# EAGLE board BMS (EAGLE 7.5.0), part 2 of 2
## Tracks (layer width: path | path; a pad name or v marks a point on that pad's centre or on a via) (continued)
N$18 (continued)
  Top 0.406: R57.P$2 112.17,65.15 R56.P$2 119.13,66.42 119.63,65.91 120.58,65.91 | D5.A 120.8,66.73 121.06,66.98 124.43,66.98 124.79,66.62 124.79,65.99 Q8.2
N$19
  Top 0.178: 120.68,63.72 D5.C
  Top 0.406: R19.2 120.68,63.72
N$20
  Top 0.178: Q6.1 122.9,52.51 123.01,52.4 127.1,52.4 127.28,52.58 127.28,53.47 127.64,53.82 128.23,53.82 R21.1
N$21
  Top 0.178: 120.87,53.82 D6.A
  Top 0.406: R52.P$2 112.42,51.44 R53.P$2 117.25,51.44 117.68,51.87 117.68,53.47 118.03,53.82 120.87,53.82 | D6.A 121.42,54.01 121.95,54.53 124.61,54.53 124.79,54.36 124.79,53.49 Q6.2
N$22
  Top 0.178: 119.16,51.91 R22.2
  Top 0.406: D6.C 119.16,51.91
N$23
  Top 0.178: 123.63,61.65 Q7.3 123.85,61.85 123.29,62.41 123.29,64.21 123.57,64.49 125.81,64.49 126.75,65.43 129.08,65.43 129.44,65.07 129.44,64.48 R17.1 | 118.43,62.1 R19.1
  Top 0.406: R19.1 122.47,62.02 | 122.47,62.02 122.83,61.65 123.63,61.65 | R57.P$1 118.43,62.1 | F30.2 122.52,62.07 122.47,62.02
  Bottom 0.178: R56.P$1 108.55,66.42
  Bottom 0.406: 108.55,66.42 R57.P$1
N$24
  Top 0.178: Q7.1 122.9,58.56 123.19,58.27 126.75,58.27 127.1,58.62 127.1,59.16 127.28,59.33 128.31,59.33 R24.1
N$25
  Top 0.178: 121.05,59.33 D7.A | 124.79,59.34 Q7.2
  Top 0.406: R55.P$2 R54.P$2 117.6,58.55 118.39,59.33 121.05,59.33 | D7.A 121.06,60.05 121.41,60.4 124.43,60.4 124.79,60.05 124.79,59.34
N$26
  Top 0.178: 119.16,57.24 R25.2
  Top 0.406: D7.C 119.16,57.24
N$27
  Top 0.178: 118.81,55.19 R25.1 | 123.83,55.6 Q6.3 123.85,56.44 124.08,56.67 128.18,56.67 R23.1
  Top 0.406: R25.1 122.11,55.41 122.3,55.6 123.83,55.6 | 118.81,55.19 118.27,55.19 116.61,56.85 114.72,56.85 R55.P$1 114.69,53.16 F31.2
  Bottom 0.406: R54.P$1 109.31,58.55 R55.P$1
N$28
  Top 0.178: 119.1,50 R22.1
  Top 0.406: R22.1 124.03,50.08 Q5.3 126.16,50 F32.2 127.67,50.23 128.02,50.57 128.02,51.37 R20.1 | R52.P$1 118.57,48.13 119.1,48.67 119.1,50
  Bottom 0.406: R53.P$1 109.57,51.44 R52.P$1
N$29
  Top 0.178: Q5.1 123.08,48.73 123.37,49.02 125.32,49.02 125.68,49.38 127.99,49.38 128.35,49.02 128.35,48.4 R27.1
N$30
  Top 0.178: 120.91,48.31 D9.A
  Top 0.406: R51.P$2 R50.P$2 112.67,45.82 112.85,46 117.88,46 118.03,46.15 118.03,47.07 118.39,47.42 119.63,47.42 119.99,47.78 119.99,48.13 120.17,48.31 120.91,48.31 | D9.A 121.06,48.84 121.41,49.2 121.77,49.2 122.12,48.84 122.12,47.07 122.3,46.89 124.61,46.89 124.79,47.07 124.79,47.89 Q5.2
N$31
  Top 0.178: 119.16,46.07 R28.2
  Top 0.406: D9.C 119.16,46.07
N$32
  Top 0.178: 128.26,44.4 R26.1 | 112.97,41.38 R51.P$1
  Top 0.406: 128.26,44.4 126.92,44.4 126.42,43.9 Q4.3 123.51,44.23 R28.1 116.43,44.23 | 116.43,44.23 115.2,44.23 114.48,43.51 114.48,41.73 114.12,41.38 112.97,41.38 | F33.2 116.43,44.23
  Bottom 0.406: R50.P$1 109.31,44.83 R51.P$1
N$33
  Top 0.178: Q4.1 122.9,40.96 123.19,40.66 126.57,40.66 127.1,41.2 128.26,41.2 R30.1
N$34  (via drill 0.5)
  Top 0.178: D10.A 121.57,42.07 | 124.79,41.81 Q4.2
  Top 0.406: 121.57,42.07 122.12,42.8 124.61,42.8 124.79,42.62 124.79,41.81 | D10.A 119.06,42.07 v119.02,42.04 | R49.P$2 108.53,34.67 R48.P$2
  Bottom 0.406: v119.02,42.04 115.52,42.04 112.93,39.45 112.93,38.23 112.6,37.9 R48.P$2
N$35
  Top 0.178: 119.15,39.97 R31.2
  Top 0.406: D10.C 119.15,39.97
N$36
  Top 0.178: 128.28,38.53 R29.1
  Top 0.406: 126.75,38.53 125.95,39.33 Q2.3 122.26,39.33 121.92,38.84 120.45,38.84 119.81,38.35 119.06,38.35 R31.1 119.1,38.32 119.1,37.85 118.72,37.47 118.03,37.47 116.89,36.32 115.6,36.32 115.14,35.87 115.14,35.18 114.63,34.67 R49.P$1 | 126.75,38.53 128.28,38.53 | 126.75,38.53 126.75,37.57 127.33,36.98 128.7,36.98 129.18,36.5 129.18,31.8 128.83,31.45 127.53,31.45 127.38,31.6 127.38,31.63 126.72,32.3 F34.2
  Bottom 0.406: R48.P$1 108.27,37.9 R49.P$1
N$37
  Top 0.178: Q2.1 123.15,36.08 123.55,35.69 R33.1
N$38
  Top 0.406: R47.P$2 112.17,31.37 R46.P$2 113.06,31.75 117.27,31.75 117.58,32.05 117.58,35.87 118.03,36.32 119.48,36.32 119.71,36.55 119.71,36.86 120.1,37.25 D11.A 121.06,38 121.23,38.18 124.79,38.18 125.05,37.91 Q2.2
N$39
  Top 0.178: 120.93,35.27 D11.C
  Top 0.406: R34.2 120.93,35.27
N$40  (via drill 0.5)
  Top 0.178: 119.11,33.48 R34.1
  Top 0.406: R34.1 119.02,31.52 118.39,30.89 115.54,30.89 115.01,30.35 115.01,28.4 114.66,28.04 112.64,28.04 R47.P$1 | R32.1 127.74,33.48 Q1.3 119.11,33.48 | v120.88,26.09 120.88,25.73 120.35,25.2 119.42,25.2 F35.2
  Bottom 0.178: 112.64,28.04 R47.P$1
  Bottom 0.406: R46.P$1 109.31,31.37 R47.P$1 | 112.64,28.04 115.72,28.04 116.28,27.48 117.5,26.26 120.7,26.26 v120.88,26.09
N$41
  Top 0.178: Q1.1 122.62,30.67 122.94,30.35 125.04,30.35 125.27,30.58 125.27,31.37 125.53,31.45 126.82,31.45 127.08,31.19 127.08,30.43 127.36,30.15 128.79,30.15 R36.1
N$42
  Top 0.406: R45.P$2 112.45,25.02 R44.P$2 114.66,25.02 114.83,25.2 114.83,27.15 117.86,30.17 119.46,30.17 119.81,30.53 119.81,31.06 119.99,31.24 120.96,31.24 D12.A 121.06,32.13 121.41,32.49 124.26,32.49 124.43,32.31 124.43,31.47 Q1.2
N$43
  Top 0.178: 118.89,29.05 R37.2
  Top 0.406: D12.C 118.89,29.05
N$44
  Top 0.178: Q3.1 123.15,22.92 123.55,22.53 127.1,22.53 127.64,23.06 127.64,23.6 127.81,23.77 128.82,23.77 R39.1
N$45
  Top 0.178: 119.15,21.68 R40.2
  Top 0.406: D13.C 119.15,21.68
N$46
  Top 0.178: 128.16,90.89 R4.1 128.52,91.25 | 137.08,91.54 137.11,68.35 137.41,68.05 138.44,68.05 R2.1 R3.1 | 136.3,92.33 128.52,92.33 | 136.3,92.33 137.08,91.54 | 136.3,92.33 137.08,91.54
  Top 0.406: Q12.3 128.16,90.89 | 128.52,91.25 128.52,92.33 128.52,105.56 128.56,105.56 F25.2
N$47
  Top 0.178: 125.15,23.86 Q3.2 | 117.68,18.65 117.57,18.54
  Top 0.406: R43.P$2 117.57,18.54 118.03,18.08 118.03,15.36 R42.P$2 | 125.15,23.86 125.15,24.49 124.79,24.84 121.41,24.84 121.06,24.49 D13.A 118.22,23.78 117.68,23.24 117.68,18.65
N$48
  Top 0.178: R42.P$1 | R38.1 128.84,17.36 128.52,17.04 R41.1 129.06,17
  Top 0.406: R40.1 119.02,17.98 120.52,16.48 | 120.52,16.48 120.52,14.17 119.46,13.11 116.26,13.11 115.72,13.64 114.83,13.64 114.3,14.17 R42.P$1 | 128.52,17.04 124.49,17.04 | 124.49,17.04 121.08,17.04 120.52,16.48 | U$1.1 125.92,6.59 124.84,7.67 124.84,16.68 124.49,17.04
  Bottom 0.178: 114.23,15.42 R42.P$1
  Bottom 0.406: R43.P$1 108.81,16.11 109.5,15.42 114.23,15.42
N$49
  Top 0.178: 124.08,25.89 Q3.3 | 128.66,26.62 R35.1 | R45.P$1
  Top 0.406: 124.08,25.89 124.08,27.15 123.76,27.47 R37.1 116.32,27.47 115.9,26.97 115.9,22.35 115.37,21.82 R45.P$1 | Q3.3 127.06,25.86 127.81,26.62 128.66,26.62 | F36.2 129.48,15.56 129.9,15.98 129.9,19.74 129.69,19.94 129.69,24.89 128.98,25.6 128.98,26.66 R35.1
  Bottom 0.406: R44.P$1 109.82,25.02 R45.P$1
N$50  (via drill 0.3)
  Top 0.406: R2.2 139.9,69.79 139.99,69.87 139.99,70.31 | C2.1 139.99,70.31 | v140.74,70.31 139.99,70.31
  Bottom 0.178: 2.C 140.78,70.04 141.05,70.31 v140.74,70.31
N$52
  Top 0.178: R67.8 R67.7 R67.6 R67.5 139.01,36.37 139.01,36.4 138.82,36.2
  Top 0.406: Q13.2 138.82,36.17 R67.5
N$53
  Top 0.178: R68.1 138.78,28.99 138.82,28.95 | 138.84,28.93 140.2,28.93 R66.1
  Top 0.406: Q13.1 138.82,28.95 138.84,28.93
N$55
  Top 0.178: Q25.1 16.73,93.15 17.17,92.71 23.74,92.71 R154.1
N$56
  Top 0.178: 13.72,97.54 D25.A 13.76,97.54
  Top 0.406: R211.P$2 2.72,97.61 R212.P$2 7.85,101.14 11.46,97.54 13.72,97.54 | Q25.2 18.63,94.81 18.44,95 16.15,95 15.65,95.5 15.65,97.16 15.27,97.54 13.76,97.54
N$57
  Top 0.178: 13.44,95.72 D25.C
  Top 0.406: R156.2 13.44,95.72
N$58  (via drill 0.5)
  Top 0.178: 11.37,93.98 R156.1 11.42,94 | 23.8,85.34 R153.1
  Top 0.406: R211.P$1 8.33,97.61 9.04,96.9 9.04,94.74 9.8,93.98 11.37,93.98 | 23.8,85.34 20.73,85.34 20.35,85.72 20.35,88.39 19.83,88.91 Q24.3 16.1,88.91 15.8,89.2 15.8,93.47 15.27,94 11.42,94 | R153.1 23.88,87.35 v23.8,87.43 | F2.2 v36.25,92.94
  Bottom 0.406: R212.P$1 2.66,101.14 R211.P$1 | v23.8,87.43 35.71,87.43 36.25,87.96 v36.25,92.94
N$59
  Top 0.178: R155.1 21.82,83.24 19.46,85.6 17.17,85.6 16.92,85.85 16.92,86.75 Q24.1
N$60
  Top 0.178: 14.12,88.63 D26.A 14.23,88.52
  Top 0.406: R210.P$2 2.57,88.59 R209.P$2 13.16,92.15 14.12,91.19 14.12,88.63 | Q24.2 18.76,87.57 18.44,87.88 15.75,87.88 15.11,88.52 14.23,88.52
N$61
  Top 0.178: 14.07,86.32 D26.C
  Top 0.406: R157.2 14.07,86.32
N$62
  Top 0.178: 12,84.58 R157.1 | 17.38,82.93 Q23.3 | 23.61,80.85 R152.1 23.7,80.84
  Top 0.406: R210.P$1 9.5,88.57 10.19,87.88 10.19,85.09 10.69,84.58 12,84.58 | R157.1 13.96,84.62 15.65,82.93 17.38,82.93 | Q23.3 20.64,82.76 20.96,82.45 20.96,81.2 21.31,80.85 23.61,80.85 | 23.7,80.84 23.7,81.74 23.8,81.91 24.51,81.91 24.69,82.09 24.66,82.12 24.66,83.92 24.74,84 24.74,86.18 25.04,86.49 25.04,88.14 24.69,88.49 21.84,88.49 21.53,88.81 F3.2
  Bottom 0.406: R209.P$1 2.73,92.15 R210.P$1
N$63
  Top 0.178: Q23.1 16.6,78.8 17.04,78.36 R159.1
N$64
  Top 0.178: 13.9,80.9 D27.A
  Top 0.406: R208.P$2 2.31,81.03 R207.P$2 9.17,84.84 10.82,83.19 10.82,81.53 11.46,80.9 13.9,80.9 | Q23.2 18.5,81.35 18.06,81.79 15.39,81.79 14.76,82.42 14.12,82.42 14,82.3 D27.A
N$65
  Top 0.178: D27.C
  Top 0.406: R160.2 D27.C
N$66  (via drill 0.5)
  Top 0.178: 11.67,76.96 R160.1 | 23.52,75.27 R158.1
  Top 0.406: R208.P$1 9.3,80.64 9.93,80.01 9.93,77.22 10.19,76.96 11.67,76.96 | R160.1 17,77 17.68,76.33 Q22.3 23.52,75.27 | R158.1 23.69,76.75 23.98,77.11 v27.18,77.11 | v36.42,75.87 36.42,77.51 F4.2
  Bottom 0.406: R207.P$1 2.37,84.33 R208.P$1 | v27.18,77.11 34.11,77.11 34.65,76.58 34.65,75.87 35,75.51 36.07,75.51 v36.42,75.87
N$67
  Top 0.178: Q22.1 16.73,72.45 18.82,70.36 20.98,70.36 21.74,69.6 R162.1
N$68
  Top 0.178: R206.P$2 2.18,73.15 | 13.9,75.18 D28.A 14.03,75.06
  Top 0.406: 2.18,73.15 R205.P$2 8.79,76.96 10.57,75.18 13.9,75.18 | Q22.2 18.63,73.85 18.31,74.17 16.92,74.17 16.03,75.06 14.03,75.06
N$69
  Top 0.178: D28.C
  Top 0.406: R163.2 D28.C
N$70
  Top 0.178: 11.37,71.37 R163.1 11.62,71.12 | 17.72,69.47 Q21.3
  Top 0.305: 23.42,67.45 R161.1
  Top 0.406: R206.P$1 7.9,73.02 9.55,71.37 11.37,71.37 | Q21.3 17.68,70.61 17.17,71.12 11.62,71.12 | 17.72,69.47 19.33,69.47 19.58,69.21 19.58,68.71 20.94,67.35 R161.1 23.77,67.59 | F5.2 21.35,71.59 21.79,71.14 24,71.14 24.28,70.87 24.28,68.63 24,68.35 23.67,68.35 23.42,68.1 23.42,67.45
  Bottom 0.406: R205.P$1 2.24,76.71 R206.P$1
N$71
  Top 0.178: Q21.1 16.73,66.35 17.04,66.04 18.82,66.04 21.49,64.08 R165.1
N$72
  Top 0.178: 18.57,67.39 Q21.2
  Top 0.406: R204.P$2 2.57,65.79 R203.P$2 11.96,69.09 12.6,69.72 13.87,69.72 14.25,69.34 D29.A 18.28,68.23 18.57,67.94 18.57,67.39
N$73
  Top 0.178: D29.C
  Top 0.406: R166.2 D29.C
N$74
  Top 0.178: Q19.1 16.98,51.24 17.81,50.42 R168.1
N$75
  Top 0.406: R199.P$2 3.33,48.26 6.25,51.18 6.25,52.58 R200.P$2 6.38,54.1 6.76,54.48 13.96,54.48 D30.A 14.34,54.86 18.57,54.86 18.88,54.55 Q19.2
N$76
  Top 0.406: R169.2 D30.C
N$77  (via drill 0.5)
  Top 0.178: 11.92,64.39 R166.1 | 23.8,60.06 R164.1
  Top 0.406: R204.P$1 8.92,65.41 9.93,64.39 11.92,64.39 | R166.1 15.69,64.43 16.28,65.02 17.55,65.02 17.93,64.64 Q20.3 19.88,63.71 20.6,62.99 20.6,60.71 21.36,59.94 R164.1 | v23.8,62.36 23.8,60.06 | F6.2 34.38,62.8 v35,62.18
  Bottom 0.406: R203.P$1 2.63,69.09 R204.P$1 | v35,62.18 25.58,62.18 25.4,62.36 v23.8,62.36
N$78
  Top 0.178: Q20.1 16.98,59.24 18.57,57.66 R171.1
N$79
  Top 0.178: 14.16,61.47 D31.A | 18.82,61.67 Q20.2
  Top 0.406: R202.P$2 2.69,57.91 R201.P$2 14.16,61.47 | D31.A 14.38,62.23 14.76,62.61 18.57,62.61 18.82,62.36 18.82,61.67
N$80
  Top 0.178: D31.C
  Top 0.406: R172.2 D31.C
N$81
  Top 0.178: 12,57.53 R172.1
  Top 0.406: R202.P$1 10.06,57.02 10.57,57.53 12,57.53 | R172.1 17.51,57.44 17.93,57.02 Q19.3 20.81,55.96 F7.2 21.53,53.14 R170.1
  Bottom 0.406: R201.P$1 2.5,60.97 R202.P$1
N$82  (via drill 0.5)
  Top 0.178: 23.61,48.31 R167.1 23.62,48.32
  Top 0.406: R199.P$1 9.42,47.62 11.2,49.4 | 11.2,49.4 R169.1 | 11.2,49.4 17.3,49.4 17.68,49.02 Q18.3 21.24,46.82 21.67,47.24 21.67,47.96 22.02,48.31 22.56,48.31 | 22.56,48.31 23.61,48.31 | F8.2 v32.87,43.51 | v22.63,46.84 22.63,48.23 22.56,48.31
  Bottom 0.406: R200.P$1 2.63,52.08 R199.P$1 | v32.87,43.51 32.87,45.82 32.33,46.36 23.11,46.36 v22.63,46.84
N$83
  Top 0.178: Q18.1 16.73,43.75 17.17,43.31 20.85,43.31 21.49,43.94 21.49,44.96 21.87,45.34 R174.1
N$84
  Top 0.406: R198.P$2 3.07,39.37 R197.P$2 7.14,45.72 7.65,46.23 14.09,46.23 D32.A 14.16,46.23 15.27,46.23 15.65,45.85 18.44,45.85 18.63,45.66 Q18.2
N$85
  Top 0.406: D32.C R175.2
N$86
  Top 0.178: 17.38,41.91 Q17.3
  Top 0.406: R198.P$1 6.82,38.68 10.57,42.42 11.8,42.42 R175.1 15.99,42.46 16.54,41.91 17.38,41.91 | Q17.3 20.11,41.87 20.24,41.73 20.24,41.24 F9.2 20.28,42.3 20.6,42.62 22.38,42.62 22.73,42.98 23.74,42.98 R173.1
  Bottom 0.406: R197.P$1 3.39,42.04 R198.P$1
N$87
  Top 0.178: Q17.1 16.47,38.8 16.92,38.35 21.87,38.35 22.12,38.61 22.12,39.5 22.5,39.88 23.69,39.88 R177.1
N$88
  Top 0.178: 18.31,39.71 Q17.2
  Top 0.406: R196.P$2 3.45,30.99 R195.P$2 6.88,36.7 7.39,37.21 9.8,37.21 10.31,37.72 10.31,39.5 10.82,40.01 13.71,40.01 D33.A 13.74,41.02 14.12,41.4 14.76,41.4 15.39,40.77 18.06,40.77 18.31,40.51 18.31,39.71
N$89
  Top 0.406: D33.C R178.2
N$90  (via drill 0.5)
  Top 0.178: 17.13,36.23 Q15.3 | 11.54,36.2 R178.1 | 23.52,34.84 R176.1
  Top 0.406: R178.1 17.13,36.23 | R196.P$1 8.66,30.23 9.3,30.86 9.3,35.43 10.06,36.2 11.54,36.2 | Q15.3 22.8,36.28 23.52,35.56 23.52,34.84 | v22.02,34.8 R176.1 | F10.2 v35.71,35.15
  Bottom 0.406: R195.P$1 3.13,34.3 R196.P$1 | v35.71,35.15 35.71,35.69 31.55,35.69 30.63,34.77 22.05,34.77 v22.02,34.8
N$91
  Top 0.178: Q15.1 16.22,34.86 16.54,35.18 20.73,35.18 21.11,34.8 21.11,32.77 21.62,32.26 R180.1
N$92
  Top 0.178: 14.03,33.91 D34.A 13.96,33.91
  Top 0.406: R194.P$2 3.45,22.86 R193.P$2 7.01,26.29 7.01,27.81 7.65,28.45 9.8,28.45 10.31,28.96 10.31,33.27 10.95,33.91 13.96,33.91 | Q15.2 18.12,33.21 17.81,32.89 15.52,32.89 15.27,33.15 15.27,33.66 15.01,33.91 14.03,33.91
N$93
  Top 0.178: 13.83,32 D34.C
  Top 0.406: R181.2 11.58,31.62 11.96,32 13.83,32
N$94
  Top 0.178: 17.76,29.59 Q14.3 | 24.03,29.76 R179.1
  Top 0.406: 17.76,29.59 13.49,29.59 12.89,28.99 R181.1 11.58,25.65 9.55,23.62 7.52,23.62 7.2,23.31 R194.P$1 | 24.03,29.76 24.03,28.98 24.69,28.32 24.69,21.41 24.16,20.88 23.28,20.88 F11.2 | Q14.3 18.65,29.55 19.46,30.35 23.58,30.35 R179.1
  Bottom 0.406: R193.P$1 3.13,26.04 R194.P$1
N$95
  Top 0.178: Q14.1 16.86,26.48 17.17,26.16 20.35,26.16 20.98,26.8 22.25,26.8 22.76,27.3 23.69,27.3 R183.1
N$96
  Top 0.178: 18.82,27.51 Q14.2
  Top 0.406: R192.P$2 3.49,15.15 R191.P$2 6.88,18.54 8.41,18.54 9.04,19.18 9.04,22.1 12.34,25.4 12.34,27.94 12.63,28.23 D35.A 15.09,28.22 15.44,28.57 18.64,28.57 18.82,28.4 18.82,27.51
N$97
  Top 0.406: D35.C 14.25,23.62 13.83,23.2 R184.2
N$98
  Top 0.178: Q16.1 15.97,22.93 16.41,23.44 19.2,23.44 19.84,22.73 R186.1
N$99
  Top 0.178: 12.38,16.12 D36.C
  Top 0.406: R187.2 12.38,16.12
N$100
  Top 0.178: 25.43,96.14 25.43,95.88 | 25.43,94.86 R151.1 25.46,94.89 32.16,94.89 32.51,94.54 32.51,68.05 32.87,67.69 38.56,67.69 39.27,66.98 39.27,66.09 39.8,65.56 41.06,65.56 R150.1 41.25,67.12 R149.1 | 39.05,101.12 F1.2
  Top 0.406: Q25.3 19.08,96.02 19.58,96.52 25.04,96.52 25.43,96.14 | 25.43,94.86 25.43,95.88 28.09,98.55 32.79,98.55 35.36,101.12 39.05,101.12
N$101
  Top 0.406: D36.A 14.72,13.81 R189.P$2 19.93,19.01 R190.P$2 17.87,21.58 Q16.2
N$102
  Top 0.178: Q38.1 76.11,91.02 76.43,91.34 79.98,91.34 80.52,91.87 80.52,92.76 80.7,92.94 81.17,92.94 R79.1 81.29,93.12
N$103
  Top 0.178: 78.03,90.37 Q38.2 | 73.01,93.47 D8.A
  Top 0.406: R137.P$2 63.91,91.74 R136.P$2 64.06,91.69 67.01,91.69 67.54,91.16 69.67,91.16 70.43,91.74 70.43,93.17 70.92,93.47 73.01,93.47 | D8.A 74.13,93.45 74.65,93.12 74.65,89.74 75.36,89.03 77.67,89.03 78.03,89.38 78.03,90.37
N$104
  Top 0.406: R81.2 73.03,89.88 D8.C
N$105
  Top 0.178: 16.15,19.5 R190.P$1 | 37.82,5.08 U$14.1 | R188.1 33.01,17.34 R185.1 31.19,17.21 | 25.93,15.69 25.9,15.66
  Top 0.406: R187.1 15.9,18.29 16.15,18.54 16.15,19.5 | R189.P$1 25.9,15.66 36.47,5.08 37.82,5.08 | R185.1 26.25,17.34 25.93,17.02 25.93,15.69
  Bottom 0.406: R190.P$1 16.46,19.52 R189.P$1
N$106  (via drill 0.5)
  Top 0.178: 16.75,24.64 Q16.3 16.93,24.49 | 12.6,21.38 R184.1
  Top 0.406: R184.1 14.42,21.5 15.01,22.1 15.01,24 15.65,24.64 16.75,24.64 | R192.P$1 10.73,15.02 11.2,15.49 11.2,19.43 11.84,20.07 12.22,20.07 12.6,20.45 12.6,21.38 | R182.1 22.38,25.02 | 22.38,25.02 19,25.02 18.47,24.49 16.93,24.49 | v21.84,23.95 21.84,24.49 22.38,25.02 | F12.2 31.31,13.07 v31.27,13.11
  Bottom 0.178: 22.02,23.77 v21.84,23.95
  Bottom 0.406: R191.P$1 3.76,18.51 R192.P$1 | 22.02,23.77 30.38,23.77 31.27,22.88 v31.27,13.11
N$107
  Top 0.178: R149.2 43,69.28 C64.1 47.14,69.35 3.C
N$108
  Top 0.406: F14.2 85.62,98.97 85.62,97.87 85.19,97.43 82.63,97.43 82.14,96.95 82.14,94.87 82.19,94.82 82.19,91.95 81.4,91.15 R78.1 80.52,90.63 79.98,90.09 79.98,88.14 79.15,87.31 Q37.3 77.6,87.43 76.78,87.43 76.07,88.14 73.09,88.14 R81.1 73.05,88.11 R137.P$1
  Bottom 0.178: R136.P$1 60.26,91.7 | 60.25,91.69 60.44,91.69
  Bottom 0.406: 60.26,91.7 60.25,91.69 | 60.44,91.69 R137.P$1
N$110
  Top 0.178: Q37.1 76.77,84.41 77.14,84.05 79.45,84.05 79.81,84.4 79.81,87.07 80.34,87.6 81.27,87.6 R80.1
N$111
  Top 0.178: 78.74,85.27 Q37.2 | 73.52,86.54 D14.A
  Top 0.406: R135.P$2 63.5,83.97 R134.P$2 63.5,86.05 63.98,86.54 73.52,86.54 | D14.A 75.25,86.47 75.72,86.18 78.38,86.18 78.74,85.83 78.74,85.27
N$112
  Top 0.178: 70.9,84.37 R82.2
  Top 0.406: D14.C 70.9,84.37
N$113
  Top 0.178: 74.49,81.74 Q36.3 | 81.41,85.1 R77.1
  Top 0.406: 74.49,81.74 71.09,81.74 70.84,81.99 R82.1 69.84,82.79 69.49,82.45 69.49,82.27 | 69.49,82.27 69.49,80.72 69.32,80.47 63.59,80.47 R135.P$1 | Q36.3 80.07,81.8 81.38,83.26 81.41,85.1 | F15.2 69.28,82.49 69.49,82.27
  Bottom 0.406: R134.P$1 59.75,83.8 R135.P$1
N$114
  Top 0.178: Q26.2 42.93,32.82 R214.5 R214.6 R214.7 R214.8
N$115
  Top 0.178: Q36.1 73.6,78.7 73.94,78.36 80.68,78.36 R84.1
N$116
  Top 0.178: R132.P$2 63.04,76.5 | 75.54,79.74 Q36.2 | 70.65,79.78 D15.A
  Top 0.406: 63.04,76.5 R133.P$2 | D15.A 72.2,79.81 73.05,80.67 75.18,80.67 75.54,80.31 75.54,79.74 | R132.P$2 67.18,76.58 67.54,76.94 67.54,79.25 68.07,79.78 70.65,79.78
N$117
  Top 0.178: 70.53,77.56 D15.C
  Top 0.406: R85.2 70.53,77.56
N$118
  Top 0.178: 68.61,75.81 R85.1 | 80.87,75.98 R83.1 80.71,75.87
  Top 0.406: R133.P$1 68,72.95 68.61,73.56 68.61,74.09 | 68.61,74.09 68.61,75.81 | 68.61,74.09 71.63,74.09 72.23,73.49 Q35.3 74.04,75.44 74.47,75.87 80.71,75.87 | 80.87,75.98 80.87,76.94 81.58,77.65 81.58,79.43 81.76,79.6 85.32,79.6 85.85,80.14 85.85,81.34 F16.2
  Bottom 0.406: R132.P$1 59.6,76.58 R133.P$1
N$119
  Top 0.178: R213.1 R215.1 44.92,37.86 Q26.1
N$121
  Top 0.178: Q35.1 73.09,72.18 73.41,72.49 78.74,72.49 79.27,73.02 80.53,73.02 R87.1
N$122
  Top 0.178: 71,70.36 D16.A
  Top 0.406: R131.P$2 62.97,68.58 R130.P$2 62.97,70.94 63.45,71.42 69.93,71.42 D16.A | Q35.2 74.99,70.7 74.65,70.36 71,70.36
N$123
  Top 0.178: 70.76,68.39 D16.C
  Top 0.406: R88.2 70.76,68.39
N$124
  Top 0.178: 73.24,67.51 Q34.3
  Top 0.406: 73.24,67.51 71.98,67.51 71.16,66.69 R88.1 | R131.P$1 68.45,65.41 68.61,65.56 R88.1 | Q34.3 79.23,67.29 79.81,67.87 79.81,70.36 79.98,70.54 R86.1 | F17.2 68.58,66.66 R88.1
  Bottom 0.406: R130.P$1 59.91,69.04 R131.P$1
N$125  (via drill 0.6)
  Top 0.406: TX3.6 v148.23,104.27 | TX2.6 v148.74,86.49 | TX1.6 v148.49,95.38
  Bottom 0.406: J2.1 148.75,107 148.74,105.54 148.74,104.52 | 148.74,104.52 148.74,95.38 | 148.74,95.38 v148.74,86.49 148.77,5.06 J1.2 | v148.23,104.27 148.49,104.27 148.74,104.52 | 148.74,95.38 v148.49,95.38
N$126
  Top 0.178: Q34.1 72.51,66.08 72.69,66.27 80.52,66.27 80.87,66.62 80.87,67.75 R90.1
N$127
  Top 0.178: R128.P$2 63.35,61.9 | 70.24,63.6 D17.A | 74.47,65.13 Q34.2
  Top 0.406: 63.35,61.9 R129.P$2 | R128.P$2 66.78,61.95 67.36,62.54 68.78,62.54 69.14,62.89 69.14,63.42 69.32,63.6 70.24,63.6 | D17.A 74.23,63.53 74.47,63.78 74.47,65.13
N$128
  Top 0.178: 70.19,61.56 D17.C
  Top 0.406: R91.2 70.19,61.56
N$129  (via drill 0.6)
  Top 0.406: TX3.4 v150.01,99.19 | TX2.4 v150.01,81.41 | TX1.4 v150.01,90.3
  Bottom 0.305: 150.04,4.65 150.04,4.69 J1.1
  Bottom 0.406: 150.04,4.65 v150.01,81.41 v150.01,90.3 v150.01,99.19 150.04,106.87 J2.2
N$130
  Top 0.178: Q32.1 72.35,52.95 72.52,53.11 79.27,53.11 79.81,53.65 80.81,53.65 R93.1
N$131
  Top 0.178: 69.58,50.98 D18.A
  Top 0.406: R124.P$2 62.84,47.6 R125.P$2 65.76,47.6 66.29,48.13 66.29,48.84 66.65,49.2 67.89,49.2 68.43,49.73 68.43,50.62 68.78,50.98 69.58,50.98 | D18.A 73.92,50.96 74.12,51.16 74.12,51.85 Q32.2
N$132
  Top 0.178: 69.58,48.84 D18.C
  Top 0.406: R94.2 68.13,48.2 68.78,48.84 69.58,48.84
N$133
  Top 0.178: U3.35 48.3,54.37 48.67,54 49.43,54 C90.1
N$134
  Top 0.178: R91.1 | 72.82,59.86 Q33.3
  Top 0.406: R129.P$1 66.57,58.19 67.18,58.8 67.18,59.51 67.54,59.87 R91.1 | R91.1 72.82,59.86 | Q33.3 77.4,59.6 77.85,60.05 F18.2 80.75,60.62 R89.1
  Bottom 0.406: R128.P$1 59.63,61.95 R129.P$1
N$135  (via drill 0.3)
  Top 0.178: v145.57,54.69 U1.35
  Bottom 0.178: 144.7,54.66 145.52,54.66 v145.57,54.69
  Bottom 0.406: C30.1 144.33,54.29 144.7,54.66
N$136
  Top 0.178: Q33.1 72.13,58.23 72.52,58.62 80.61,58.62 R96.1
N$137
  Top 0.178: R126.P$2 63.12,54.43 | 68.01,57.73 D19.A | 73.76,57.23 Q33.2
  Top 0.406: 63.12,54.43 R127.P$2 | R126.P$2 66.29,54.53 66.83,55.07 66.83,57.38 67.18,57.73 68.01,57.73 | D19.A 70.65,57.82 71.09,57.38 71.09,56.85 71.63,56.31 73.41,56.31 73.76,56.67 73.76,57.23
N$138
  Top 0.406: D19.C 68.1,55.09 67.72,54.71 67.72,53.94 R97.2
N$139
  Top 0.178: 67.54,51.96 R97.1
  Top 0.406: R127.P$1 67.34,50.95 67.54,51.16 67.54,51.96 | R97.1 70.52,52.01 70.92,52.4 70.94,52.4 72.63,54.08 Q32.3 76.51,54.08 76.78,54.36 76.78,55.21 F19.2 78.38,55.25 79.48,56.34 R95.1
  Bottom 0.406: R126.P$1 59.81,54.53 R127.P$1
N$142
  Top 0.178: 67.54,46.47 R94.1 | 80.84,50.98 R92.1 81.05,50.86
  Top 0.406: R124.P$1 67.18,44.22 67.54,44.58 67.54,46.47 | R94.1 70.7,46.5 71.09,46.89 71.09,47.42 71.27,47.6 72.65,47.6 Q31.3 77.25,47.35 | 77.25,47.35 F20.2 | 80.84,50.98 77.67,50.98 77.32,50.62 77.32,47.42 77.25,47.35
  Bottom 0.406: R125.P$1 59.83,47.6 R124.P$1
N$144
  Top 0.178: Q31.1 71.95,44.26 72.16,44.04 78.38,44.04 78.92,44.58 78.92,48.13 79.27,48.49 80.56,48.49 R99.1
N$145
  Top 0.178: 69.38,44.58 D20.A
  Top 0.406: R123.P$2 62.36,40.82 R122.P$2 65.74,40.82 66.12,41.2 66.12,42.8 66.47,43.16 68.07,43.16 68.43,43.51 68.43,44.4 68.61,44.58 69.38,44.58 | D20.A 69.42,45.57 69.67,45.82 71.02,45.82 71.37,46.18 73.58,46.18 73.76,46 73.76,45.34 Q31.2
N$146
  Top 0.178: R100.2 68.93,41.95 D20.C
N$147
  Top 0.178: 81.61,43.06 R98.1
  Top 0.406: 79.1,43.06 Q30.3 76.16,43.26 75.06,43.26 74.83,43.48 71.86,43.48 71.83,43.51 70.92,43.51 70.56,43.16 70.56,41.55 70.28,41.28 68.81,41.28 68.58,41.05 68.58,40.51 68.31,40.25 R100.1 66.71,40.25 66.29,39.83 65.12,39.83 R123.P$1 | 79.1,43.06 81.61,43.06 | F21.2 79.27,42.88 79.1,43.06
  Bottom 0.406: R122.P$1 59.71,40.82 R123.P$1
N$149
  Top 0.178: Q30.1 75.4,40.45 75.9,39.95 80.16,39.95 80.52,40.31 81.47,40.31 R102.1
N$150
  Top 0.178: 77.32,40.98 Q30.2
  Top 0.406: R121.P$2 62.31,34.09 R120.P$2 64.87,34.09 65.58,34.8 65.58,38.35 66.12,38.89 68.61,38.89 69.85,40.13 71.09,40.13 71.27,40.31 71.27,42.09 71.45,42.27 72.48,42.27 D21.A 74.18,42.38 74.65,41.91 76.96,41.91 77.32,41.55 77.32,40.98
N$151
  Top 0.406: R103.2 67.36,37.85 67.51,38 69.16,38 69.39,38.23 69.49,38.38 70.1,39.09 72.39,39.09 72.62,39.32 72.62,40.25 D21.C
N$152
  Top 0.178: 67.18,34.96 R103.1 67.53,34.98
  Top 0.406: R121.P$1 65.61,30.71 66.14,31.24 66.14,32.82 67.11,33.78 67.18,34.96 | 67.53,34.98 68.43,34.98 68.75,34.65 Q28.3 75.4,34.65 76.07,35.33 79.45,35.33 79.98,35.87 79.98,36.75 80.52,37.29 R101.1 81.67,36.28 82.52,35.43 82.52,30.38 82.78,30.12 85.62,30.12 85.9,29.84 85.9,29.02 F22.2
  Bottom 0.406: R120.P$1 59.3,34.09 R121.P$1
N$154
  Top 0.178: Q28.1 72.25,31.51 72.52,31.24 75.36,31.24 75.54,31.42 75.54,33.73 76.07,34.27 81.6,34.27 R105.1
N$155
  Top 0.178: 69.2,33.2 D22.A | 74.12,32.59 Q28.2
  Top 0.406: R119.P$2 62.03,27.25 R118.P$2 65.58,27.25 65.94,27.61 65.94,29.64 66.12,29.82 66.65,29.82 66.83,30 66.83,32.49 67.54,33.2 69.2,33.2 | D22.A 70.87,33.16 71.27,33.55 73.94,33.55 74.12,33.38 74.12,32.59
N$156
  Top 0.178: R106.2 67.84,30.48 68.25,30.89 69.07,30.89 D22.C
N$159
  Top 0.178: 67.89,27.27 R106.1 | 73.13,30.17 Q27.3
  Top 0.406: R119.P$1 63.93,24.05 65.76,25.96 67.72,25.96 67.89,26.14 67.89,27.27 68.9,27.27 69.14,27.51 69.14,29.46 69.49,29.82 71.45,29.82 71.81,30.17 73.13,30.17 | R104.1 80.7,31.6 80.34,31.24 80.34,30.53 79.77,29.96 F23.2 76.61,30.13 Q27.3
  Bottom 0.406: R118.P$1 59.38,27.25 R119.P$1
N$161
  Top 0.178: Q27.1 72.23,28.82 72.52,29.11 79.81,29.11 80.52,28.4 80.52,26.62 80.87,26.26 81.7,26.26 R108.1
N$162
  Top 0.178: 70.54,26.8 D23.A | 74.12,28.02 Q27.2
  Top 0.406: R117.P$2 62.2,20.78 R116.P$2 64.77,20.78 65.1,21.11 65.48,24.51 66.09,25.2 69.14,25.2 69.49,25.55 69.49,26.62 69.67,26.8 70.54,26.8 | D23.A 73.72,26.75 74.12,27.15 74.12,28.02
N$163
  Top 0.178: 70.42,24.49 D23.C
  Top 0.406: R109.2 69,23.99 69.49,24.49 70.42,24.49
N$165
  Top 0.178: Q29.1 75.22,22.39 75.54,22.71 77.85,22.71 78.21,22.35 78.21,21.46 78.56,21.11 81.67,21.11 R111.1
N$166
  Top 0.406: D24.C 73.56,19.94 R112.2
N$170  (via drill 0.5)
  Top 0.178: Q38.3 77.06,95 | R74.1 R75.1 94.37,68.24 94.03,68.58 90.47,68.58 89.94,69.11 89.94,88.85 90.3,89.38 90.3,100.94 89.76,101.47 82.65,101.47
  Top 0.406: 77.06,95 77.67,95.61 R76.1 | Q38.3 77.06,99.8 77.85,100.58 81.76,100.58 82.65,101.47 v82.65,102.18 | v87.63,104.14 87.63,103.61 87.27,103.25 86.03,103.25 85.67,103.61 F13.2
  Bottom 0.406: v82.65,102.18 82.65,103.96 82.83,104.14 v87.63,104.14
N$175
  Top 0.178: R115.P$2 79.32,17.2
  Top 0.406: R114.P$2 79.32,17.2 77.85,17.2 77.32,17.73 77.32,20.04 77.09,20.27 | D24.A 77.09,19.94 77.09,20.27 | Q29.2 77.09,21.61 77.09,20.27
N$176
  Top 0.178: 80.16,8.5 R113.1 80.41,5.57 81.05,4.93 84.76,4.93 U$40.1 | 84.07,16.09 R110.1
  Top 0.406: 80.16,8.5 80.16,9.55 79.59,10.12 R114.P$1 83.62,13.72 84.07,14.17 84.07,16.09 | R112.1 75.68,16.45 R115.P$1
  Bottom 0.406: R115.P$1 76.11,17.2 R114.P$1
N$177  (via drill 0.5)
  Top 0.178: 62.55,17.37 R117.P$1 | 81.71,23.71 R107.1
  Top 0.406: 62.55,17.37 65.58,17.37 65.94,17.73 65.94,22 66.23,22.29 R109.1 69.61,22.29 69.85,22.53 69.85,23.24 70.21,23.6 76.07,23.6 Q29.3 79.7,23.71 80.16,23.24 v80.16,22.35 81.58,22.35 81.71,22.47 81.71,23.71 | F24.2 v86.56,15.42
  Bottom 0.406: R116.P$1 59.05,20.78 R117.P$1 | v80.16,22.35 84.61,22.35 85.14,21.82 85.14,16.48 86.21,15.42 v86.56,15.42
N$178
  Top 0.178: R74.2 100.78,67.06 C21.1 100.85,66.2 100.09,65.44 1.C
N$192
  Top 0.178: R139.5 R139.6 R139.7 R139.8 95.98,33.17 96.16,33.35 96.16,34.98 96.52,35.33 97.59,35.33 97.94,34.98 97.94,34.62 98.12,34.44 Q39.2
N$193
  Top 0.178: R140.1 99.08,30.4 Q39.1 100.94,32.54 101.12,32.36 101.12,32.5 R138.1
N$262
  Top 0.406: F12.1 36.27,11.37 U$15.1
N$264
  Top 0.406: F11.1 25.26,19.19 25.58,19.51 25.58,20.09 U$16.1
N$286
  Top 0.406: F10.1 35.71,29.54 U$17.1
N$287
  Top 0.406: F9.1 24.33,41.2 24.69,40.84 24.69,38.71 25.04,38.35 25.04,38.12 U$18.1
N$288
  Top 0.406: U$19.1 36.31,43.58 F8.1
N$289
  Top 0.406: F7.1 25.43,55.25 U$20.1
N$290
  Top 0.406: F6.1 34.46,64.5 35,63.96 36.3,63.96 U$21.1
N$291
  Top 0.406: U$22.1 23.05,72.7 F5.1
N$292
  Top 0.406: U$23.1 36.32,79.46 F4.1
N$293
  Top 0.406: F3.1 25.4,90.27 U$24.1
N$294
  Top 0.406: F2.1 36.25,98.88 U$25.1
N$295
  Top 0.406: F1.1 39.09,105.74 38.56,106.27 37.82,106.27 U$26.1
N$296
  Top 0.406: F24.1 84.82,11.9 84.43,11.51 81.77,11.51 U$41.1
N$297  (via drill 0.5)
  Top 0.406: F23.1 76.78,25.38 76.25,24.84 v72.87,24.84
  Bottom 0.406: v72.87,24.84 72.87,22.35 72.16,21.64 71.45,21.64 70.92,21.11 70.92,20.22 U$42.1
N$298
  Top 0.406: U$43.1 F22.1
N$299
  Top 0.406: U$44.1 77.02,37.7 77.67,38.35 77.67,38.89 77.85,39.07 79.23,39.07 F21.1
N$300
  Top 0.406: F20.1 81.63,46.53 U$45.1
N$301
  Top 0.406: F19.1 70.93,55.25 U$46.1
N$302
  Top 0.406: F18.1 77.85,63.6 78.21,63.96 81.67,63.96 U$47.1
N$303  (via drill 0.5)
  Top 0.406: F17.1 v66.12,70.18
  Bottom 0.406: v66.12,70.18 66.12,72.31 66.47,72.67 70.83,72.67 U$48.1
N$304
  Top 0.406: F16.1 81.77,81.38 U$49.1
N$305  (via drill 0.5)
  Top 0.406: F15.1 v67.54,85.47
  Bottom 0.406: v67.54,85.47 70.21,85.47 70.92,86.18 70.92,90.16 U$50.1
N$306
  Top 0.406: U$51.1 83.91,98.95 F14.1
N$307
  Top 0.406: U$52.1 85.54,106.02 F13.1
N$308
  Top 0.406: U$2.1 127.1,13.68 F36.1
N$309
  Top 0.406: U$3.1 116.28,21.31 116.79,21.82 116.79,23.95 117.32,24.49 117.32,25.51 F35.1
N$310
  Top 0.406: U$4.1 126.14,29.91 F34.1
N$311
  Top 0.406: U$5.1 116.3,38.49 115.9,38.89 115.9,40.7 F33.1
N$312
  Top 0.406: F32.1 126.39,47.16 U$6.1
N$313
  Top 0.406: U$7.1 116.28,53.23 F31.1
N$314
  Top 0.406: F30.1 124.97,63.42 125.5,63.96 127.1,63.96 U$8.1
N$315
  Top 0.406: F29.1 115.19,72.14 115.72,72.67 116.26,72.67 U$9.1
N$316
  Top 0.406: U$10.1 129.4,81.43 F28.1
N$317  (via drill 0.5)
  Top 0.406: F27.1 115.01,83.16 114.12,84.05 v114.12,86
  Bottom 0.406: v114.12,86 114.12,89.92 114.48,90.27 116.21,90.27 U$11.1
N$318
  Top 0.406: F26.1 126.53,95.74 127.1,96.32 127.1,98.92 U$12.1
N$319
  Top 0.406: F25.1 133.87,106.81 U$13.1
S1  (via drill 0.5)
  Top 0.178: U2.25 100.4,49.59 v101.85,48.13 | v86.56,20.93 83.55,20.93 R111.2
  Bottom 0.178: v101.85,48.13 91.74,48.13 90.88,47.27 90.88,21.69 90.12,20.93 v86.56,20.93
S2
  Top 0.178: U2.23 88.26,50.09 87.93,49.76 87.93,26.8 87.33,26.26 83.45,26.26 R108.2
S3
  Top 0.178: U2.21 87.78,51.09 87.07,50.37 87.07,34.95 86.56,34.44 83.48,34.44 R105.2
S4
  Top 0.178: U2.19 87.1,52.09 86.21,51.2 86.21,42.62 85.85,42.27 84.79,42.27 84.43,41.91 84.43,40.49 84.25,40.31 83.37,40.31 R102.2
S5
  Top 0.178: U2.17 85.65,53.09 85.32,52.76 85.32,49.02 84.96,48.67 82.49,48.67 R99.2
S6
  Top 0.178: U2.15 84.29,54.09 83.74,53.54 82.61,53.54 R93.2
S7
  Top 0.178: U2.13 85.43,55.09 84.99,55.6 84.99,58.12 84.73,58.45 R96.2
S8
  Top 0.178: U2.11 86.26,56.09 85.93,56.49 85.93,67.33 85.5,67.69 82.66,67.69 R90.2
S9
  Top 0.178: U2.9 87.24,57.09 86.79,57.46 86.79,72.57 86.16,73.2 82.46,73.2 R87.2
S10
  Top 0.178: U2.7 88.88,58.09 87.22,60.12 87.22,77.67 86.61,78.36 82.59,78.36 R84.2
S11
  Top 0.178: U2.5 89.25,59.09 88.09,60.33 88.09,86.82 87.3,87.6 83.02,87.6 R80.2
S12
  Top 0.178: U2.3 89.55,60.09 88.95,60.83 88.95,92.05 87.81,93.12 83.04,93.12 R79.2
S13
  Top 0.178: R7.2 130.14,88.49 134.75,88.49 135.86,87.6 135.86,60.4 136.08,60.18 U1.3
S14
  Top 0.178: R8.2 129.98,83.87 133.86,83.87 135,83.11 135,59.44 135.26,59.18 U1.5
S15
  Top 0.178: R12.2 130.01,76.58 133.32,76.58 134.14,75.77 134.14,58.45 134.16,58.45 134.49,58.12 137.23,58.12 U1.7
S16
  Top 0.178: R15.2 132.44,71.6 133.2,70.84 133.2,57.28 133.43,57.12 137.24,57.12 U1.9
S17
  Top 0.178: U1.11 132.57,56.18 132.33,56.49 132.33,66.62 131.9,66.98 129.83,66.98 R18.2
S18
  Top 0.178: R21.2 130.73,53.72 131.19,54.18 U1.15
S19
  Top 0.178: U1.13 131.74,55.18 131.39,55.52 131.39,58.73 131.04,59.16 130.19,59.16 R24.2
S20
  Top 0.178: U1.17 132.51,53.18 131.98,52.65 131.98,48.82 131.65,48.49 130.14,48.49 R27.2
S21
  Top 0.178: U1.19 133.23,52.18 132.84,51.87 132.84,41.71 132.41,41.2 130.11,41.2 R30.2
S22
  Top 0.178: U1.21 134.24,51.18 133.86,50.8 133.86,36.04 133.5,35.69 R33.2
S23
  Top 0.178: U1.23 134.99,50.18 134.72,49.91 134.72,30.58 134.21,30 130.64,30 R36.2
S24  (via drill 0.3, 0.5)
  Top 0.178: U1.25 144.14,49.17 143.64,48.67 142.39,48.67 v142.21,48.49 | v132.61,23.77 130.62,23.77 R39.2
  Bottom 0.178: v142.21,48.49 140.44,48.49 140.08,48.13 140.08,27.15 138.13,25.2 134.04,25.2 v132.61,23.77
S25
  Top 0.178: U3.3 31.62,59.87 31.14,60.43 31.14,91.87 30.35,92.58 25.56,92.58 R154.2
S26
  Top 0.178: U3.5 31.18,58.87 30.25,59.94 30.25,82.57 29.49,83.34 25.62,83.34 R155.2
S27
  Top 0.178: U3.7 30.63,57.87 29.39,59.26 29.39,77.75 28.78,78.36 R159.2
S28
  Top 0.178: U3.9 28.93,56.87 28.52,57.2 28.52,69.11 28.07,69.65 25.18,69.65 R162.2
S29
  Top 0.178: U3.11 28.16,55.87 27.66,56.29 27.66,63.88 27.41,64.13 25.62,64.13 R165.2
S30
  Top 0.178: U3.15 27.17,53.87 26.95,53.57 26.95,50.72 26.75,50.44 25.41,50.44 R168.2
S31
  Top 0.178: U3.13 27.38,54.87 26.82,55.42 26.82,57.38 26.47,57.73 25.59,57.73 R171.2
S32
  Top 0.178: R174.2 27.08,45.34 27.81,46.08 27.81,52.5 28.18,52.87 U3.17
S33
  Top 0.178: U3.19 29.11,51.87 28.75,51.51 28.75,40.31 28.4,39.95 25.56,39.95 R177.2
S34
  Top 0.178: U3.21 30.04,50.87 29.62,50.37 29.62,32.59 28.85,32.13 25.51,32.13 R180.2
S35
  Top 0.178: U3.23 30.87,49.87 30.48,49.4 30.48,27.71 29.72,27.33 25.62,27.33 R183.2
S36
  Top 0.178: U3.25 38.37,49.37 37.67,48.67 31.6,48.67 31.39,48.46 31.39,23.24 30.56,22.71 25.54,22.71 R186.2
SWTEN
  Top 0.178: U2.36 101.3,55.09 101.5,54.89 102.53,54.89 SJ10.1
SWTEN1  (via drill 0.3)
  Top 0.178: U1.36 139.48,55.18 v138.91,55.91
  Bottom 0.178: v138.91,55.91 138.68,56.24 138.68,57.63 SJ5.1
SWTEN2
  Top 0.178: U3.36 48.67,54.87 49.23,55.42 50.63,55.42 SJ15.1
V+
  Top 0.178: U2.1 92.53,64.55 C20.1 92.62,67.01 R75.2
V+1  (via drill 0.5)
  Top 0.178: U1.1 137.3,63.84 137.99,64.53 R3.2 v138.48,63.25
  Bottom 0.178: C1.1 138.51,63.09 v138.48,63.25
V+2
  Top 0.178: U3.1 32.58,60.87 31.98,61.47 31.98,66.62 32.51,67.16 38.2,67.16 38.74,66.62 38.74,65.56 39.73,64.57 39.83,64.52 40.28,63.96 43.09,63.96 R150.2 43.46,64.05 C63.1 43.08,63.95
VREF1
  Top 0.178: C58.1 102.15,53.35 100.97,54.53 99.42,54.53 U2.35
VREF2  (via drill 0.5)
  Top 0.178: v97.23,54.36 97.5,54.09 U2.34 100.7,54.09 101.04,53.75 101.04,52.32 101.32,52.05 103.28,52.05 103.63,51.69 103.63,33.6 103.35,33.33 99.95,33.33 99.78,33.49 Q39.3 R140.2
  Bottom 0.178: v97.23,54.36 95.57,54.36 C59.1
VREF4  (via drill 0.5)
  Top 0.178: U1.34 142.6,54.18 v142.29,54.15
  Top 0.305: v138.81,54.05 138.81,53.11 138.51,52.81 138.51,39.95 v137.97,39.42 | v136.73,33.96 136.73,32.24 Q13.3
  Top 0.406: Q13.3 136.72,29.27 136.88,29.11 136.88,29.03 R68.2
  Bottom 0.178: v142.29,54.15 140.84,54.15 C31.1 138.75,54.11 v138.81,54.05
  Bottom 0.305: v137.97,39.42 137.97,39.07 138.58,38.46 138.58,34.75 138,34.16 136.93,34.16 v136.73,33.96
VREF6
  Top 0.178: U3.34 47.58,53.87 49.23,52.22 49.23,51.93 C91.1 49.23,51.75 49.23,36.93 48.45,36.16 R215.2 46.12,35.67 Q26.3
VREG  (via drill 0.5)
  Top 0.178: U2.37 100.95,55.59 101.14,55.78 | 101.14,55.78 102.51,55.78 SJ10.2 102.55,57.72 C61.1 102.5,59.99 C60.1 102.5,62.27 102.48,62.27 102.39,62.36 101.14,62.36 100.97,62.54 100.97,63.25 101.14,63.42 101.14,65.02 101.32,65.2 102.28,65.2 | SJ9.1 SJ8.1 98.51,75.18 SJ7.1 98.49,72.53 SJ6.1 98.65,72.37 v98.65,70.36 | 102.28,65.2 1.E | 102.28,65.2 103.81,65.2 v103.99,65.38 | U2.40 100.67,57.09 100.99,56.77 100.99,55.93 101.14,55.78
  Bottom 0.178: v103.99,65.38 103.99,65.91 103.63,66.62 99.9,66.62 99.19,67.33 99.19,69.82 v98.65,70.36
VREG1  (via drill 0.3)
  Top 0.178: SJ1.1 143.19,78.63 v143.33,78.69 | v143.33,76.33 143.26,76.19 SJ2.1 143.19,75.78 143.26,75.72 | SJ3.1 143.19,74.44 v143.33,74.35 | SJ4.1 143.19,72.3 v143.33,72.29 | 141.73,55.68 U1.37 144.16,55.7 145.24,55.7 145.39,55.86 145.39,57.02 145.23,57.18 U1.40
  Top 0.254: 141.73,55.68 140.89,55.68 140.34,56.24 140.16,56.24 v140.13,56.21
  Bottom 0.178: v143.33,78.69 v143.33,76.33 143.41,76.33 143.33,76.1 v143.33,74.35 v143.33,72.29 143.26,72.29 143.26,69.32 142.8,68.86 140.06,68.86 139.83,68.64 2.E | SJ5.2 139.8,57.64 139.83,57.61
  Bottom 0.406: 2.E 139.83,65.68 | 139.83,65.68 139.83,57.61 139.83,56.51 v140.13,56.21 | C32.1 139.65,65.5 139.83,65.68
VREG2  (via drill 0.5)
  Top 0.178: 49.58,56.49 50.8,56.49 SJ15.2 52.74,56.51 C92.1 | U3.37 45.11,55.37 | 45.11,55.37 48.46,55.37 49.58,56.49 | 49.58,56.49 49.58,56.85 49.4,57.02 v48.87,57.02 | SJ14.1 46.16,81.23 SJ13.1 46.23,78.15 SJ12.1 46.29,75.44 SJ11.1 46.38,75.35 46.38,72.7 | 3.E 49.05,67.05 | 46.38,72.7 46.38,71.42 46.56,71.25 48.72,71.25 49.11,70.86 49.12,67.28 49.12,67.05 49.05,67.05 | U3.40 44.76,56.87 45.11,56.52 45.11,55.37 | C93.1 46.38,72.7 | 49.05,67.05 v49.05,62.36
  Bottom 0.178: v48.87,57.02 48.87,62.18 v49.05,62.36

## Text on the board
tNames: G. Reinbolt / R. Johnson